# EasyEDA Pro project ZH_FLIGHT_H7B0.eprj, schematic Schematic1

## Sheets
1 P1: Create Date: 2022-11-23; Page Name: P1; Project Name: ZH_FLIGHT_H7B0; Schematic Name: Schematic1
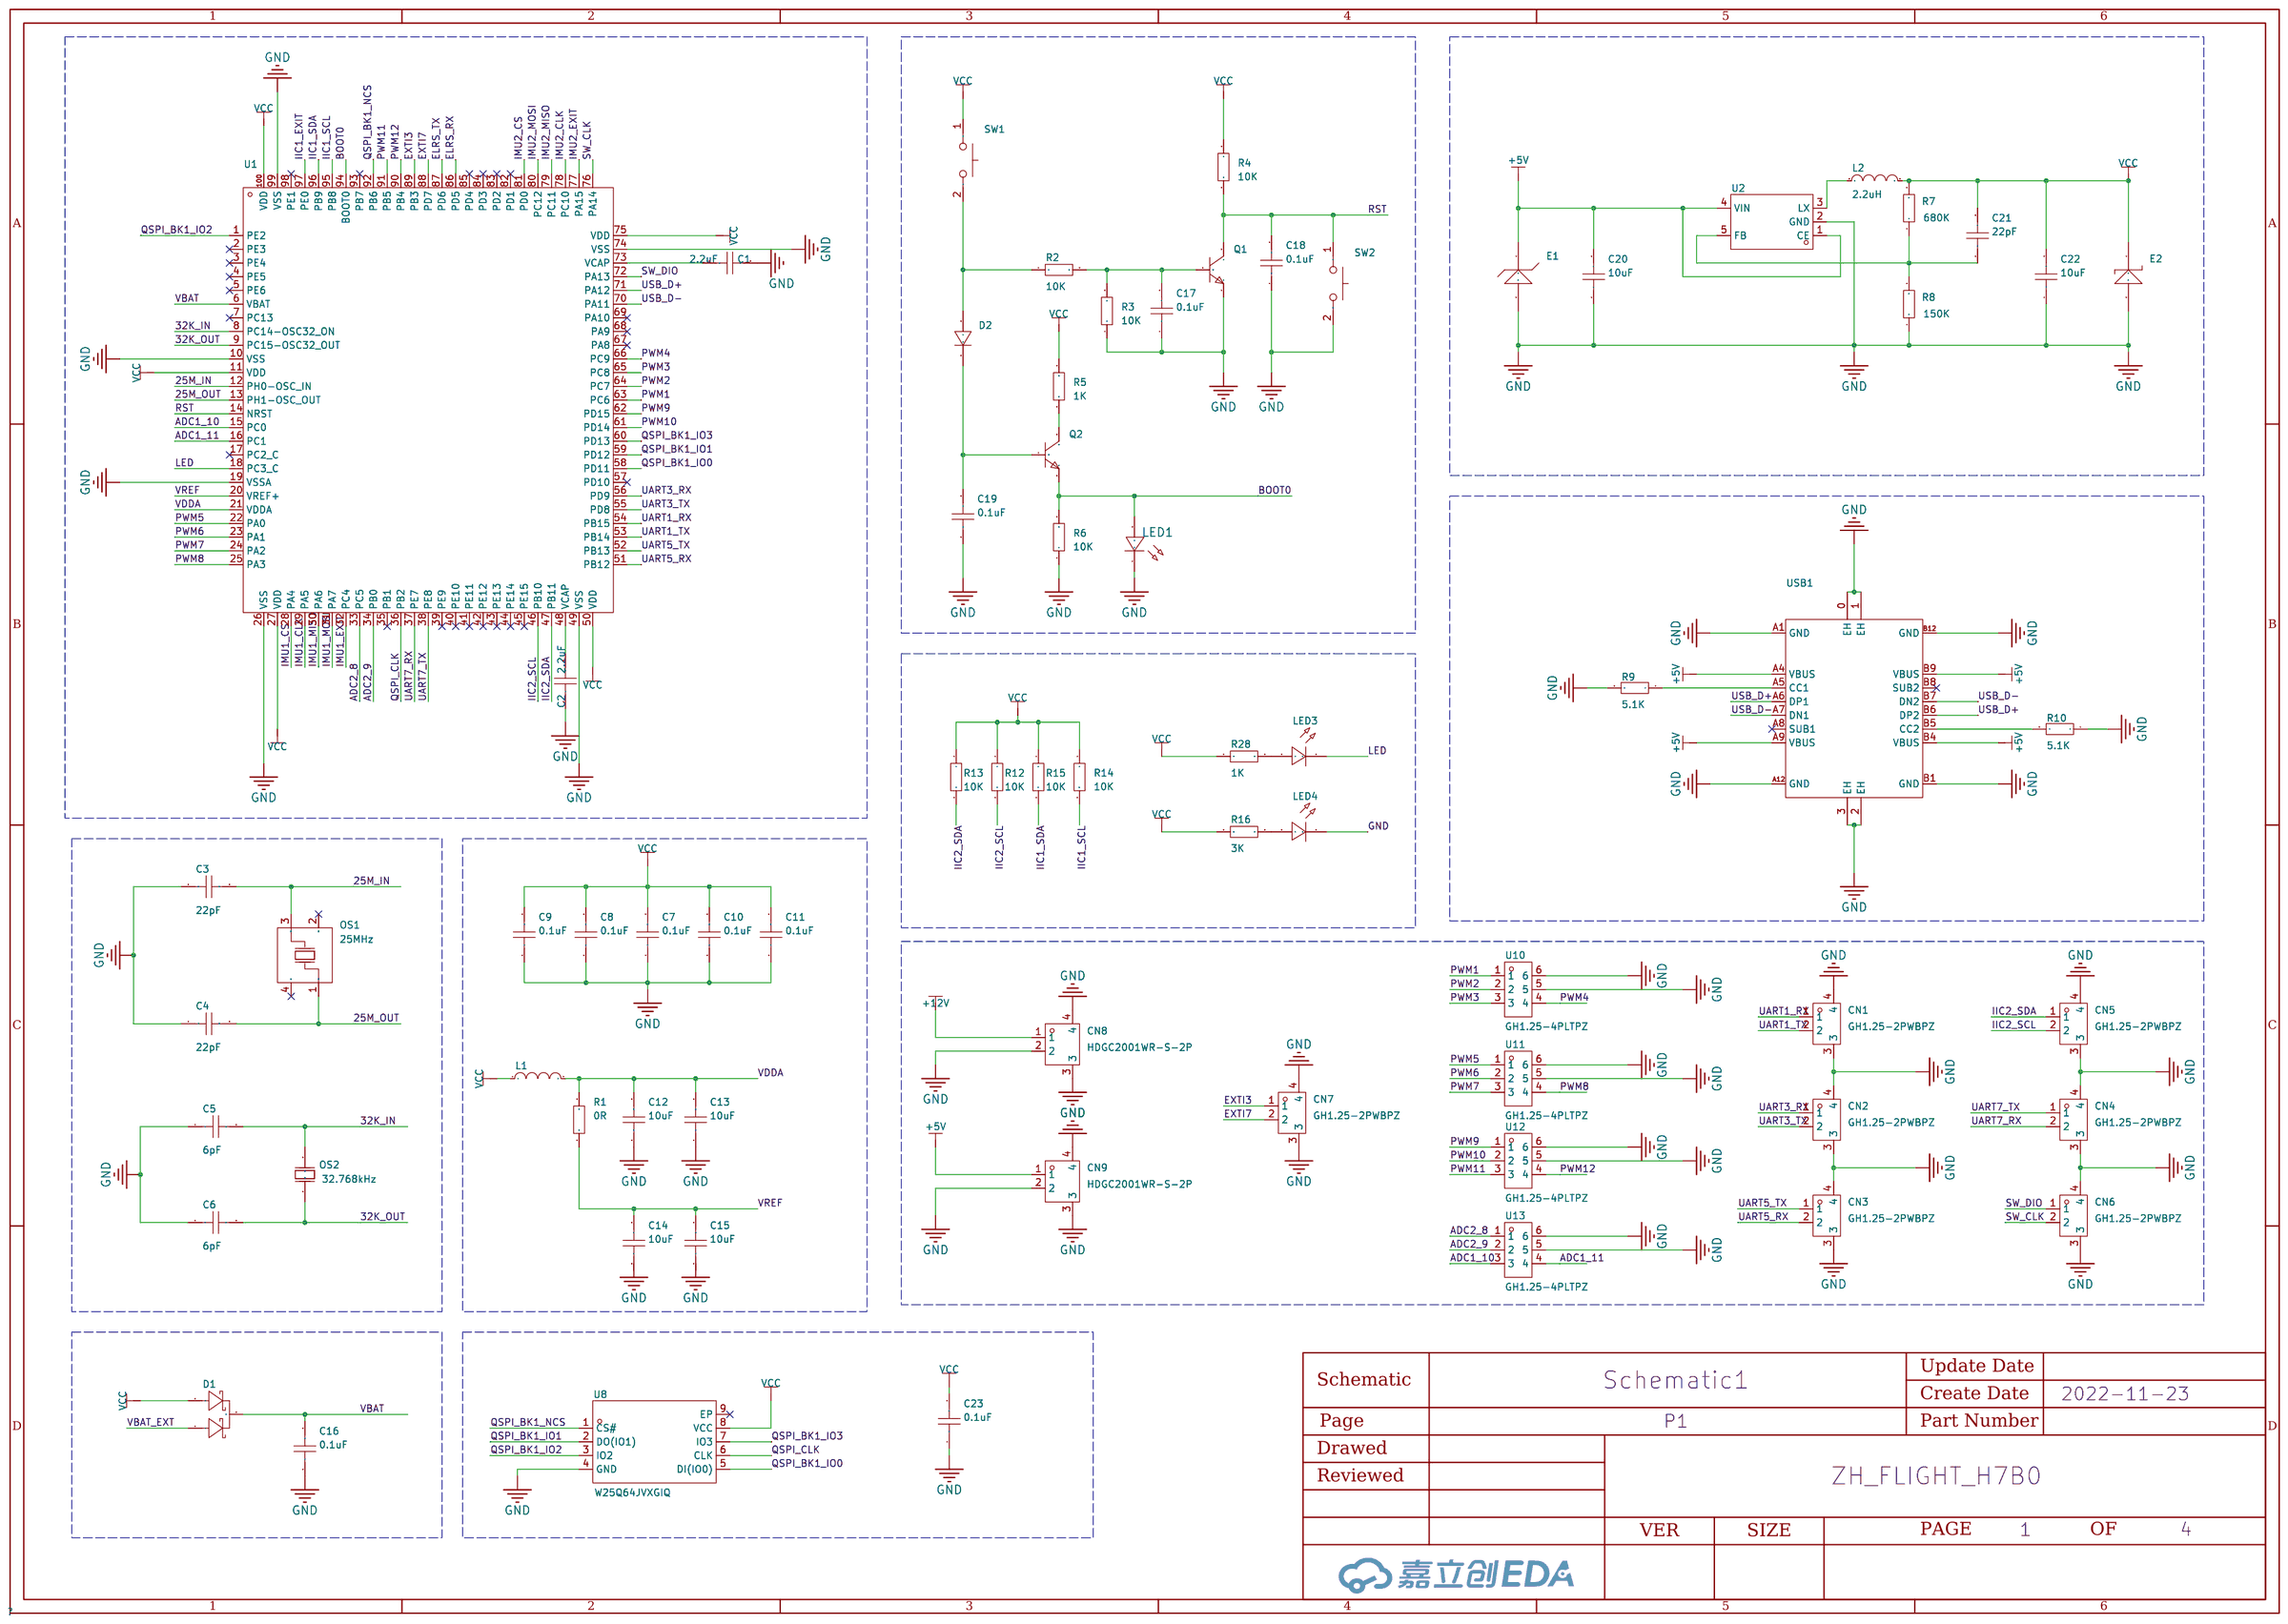
[diagram p0: P1]
2 P2: Create Date: 2022-11-27; Page Name: P2; Company: 嘉立创EDA; Page Size: A4; Version: V1.0
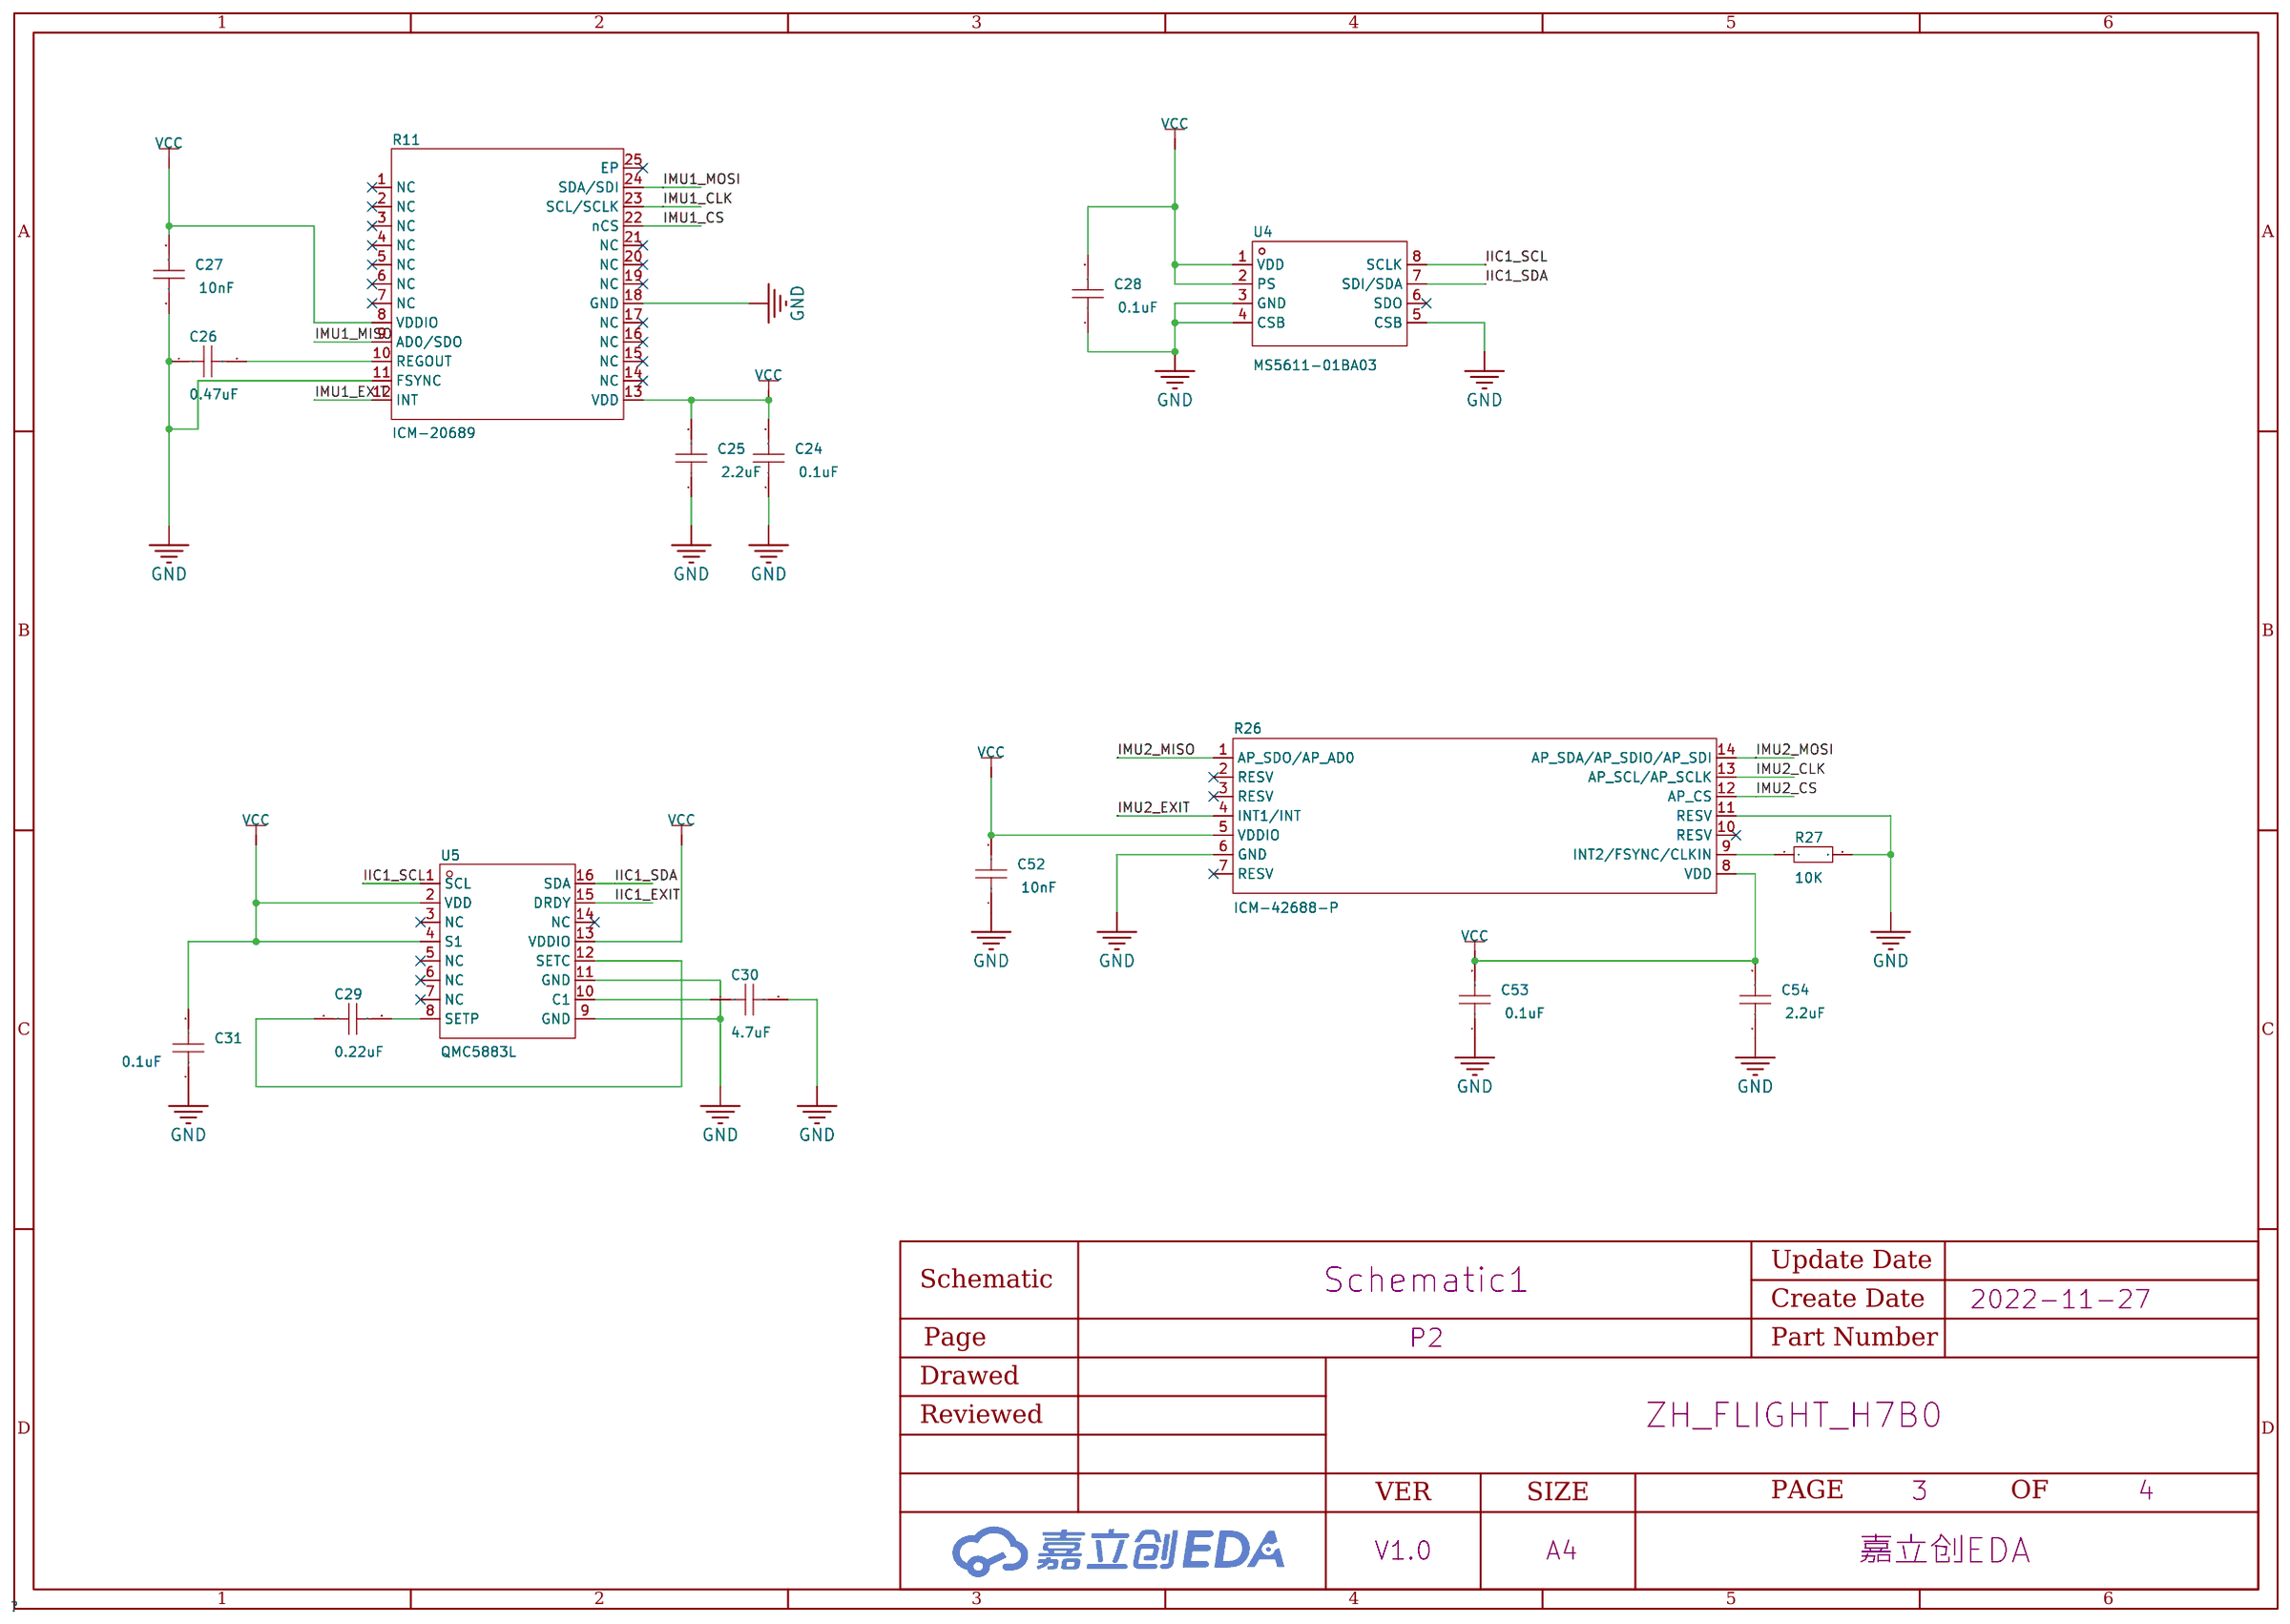
[diagram p1: P2]
3 P3: Create Date: 2022-11-28; Page Name: P3; Company: 嘉立创EDA; Page Size: A4; Version: V1.0
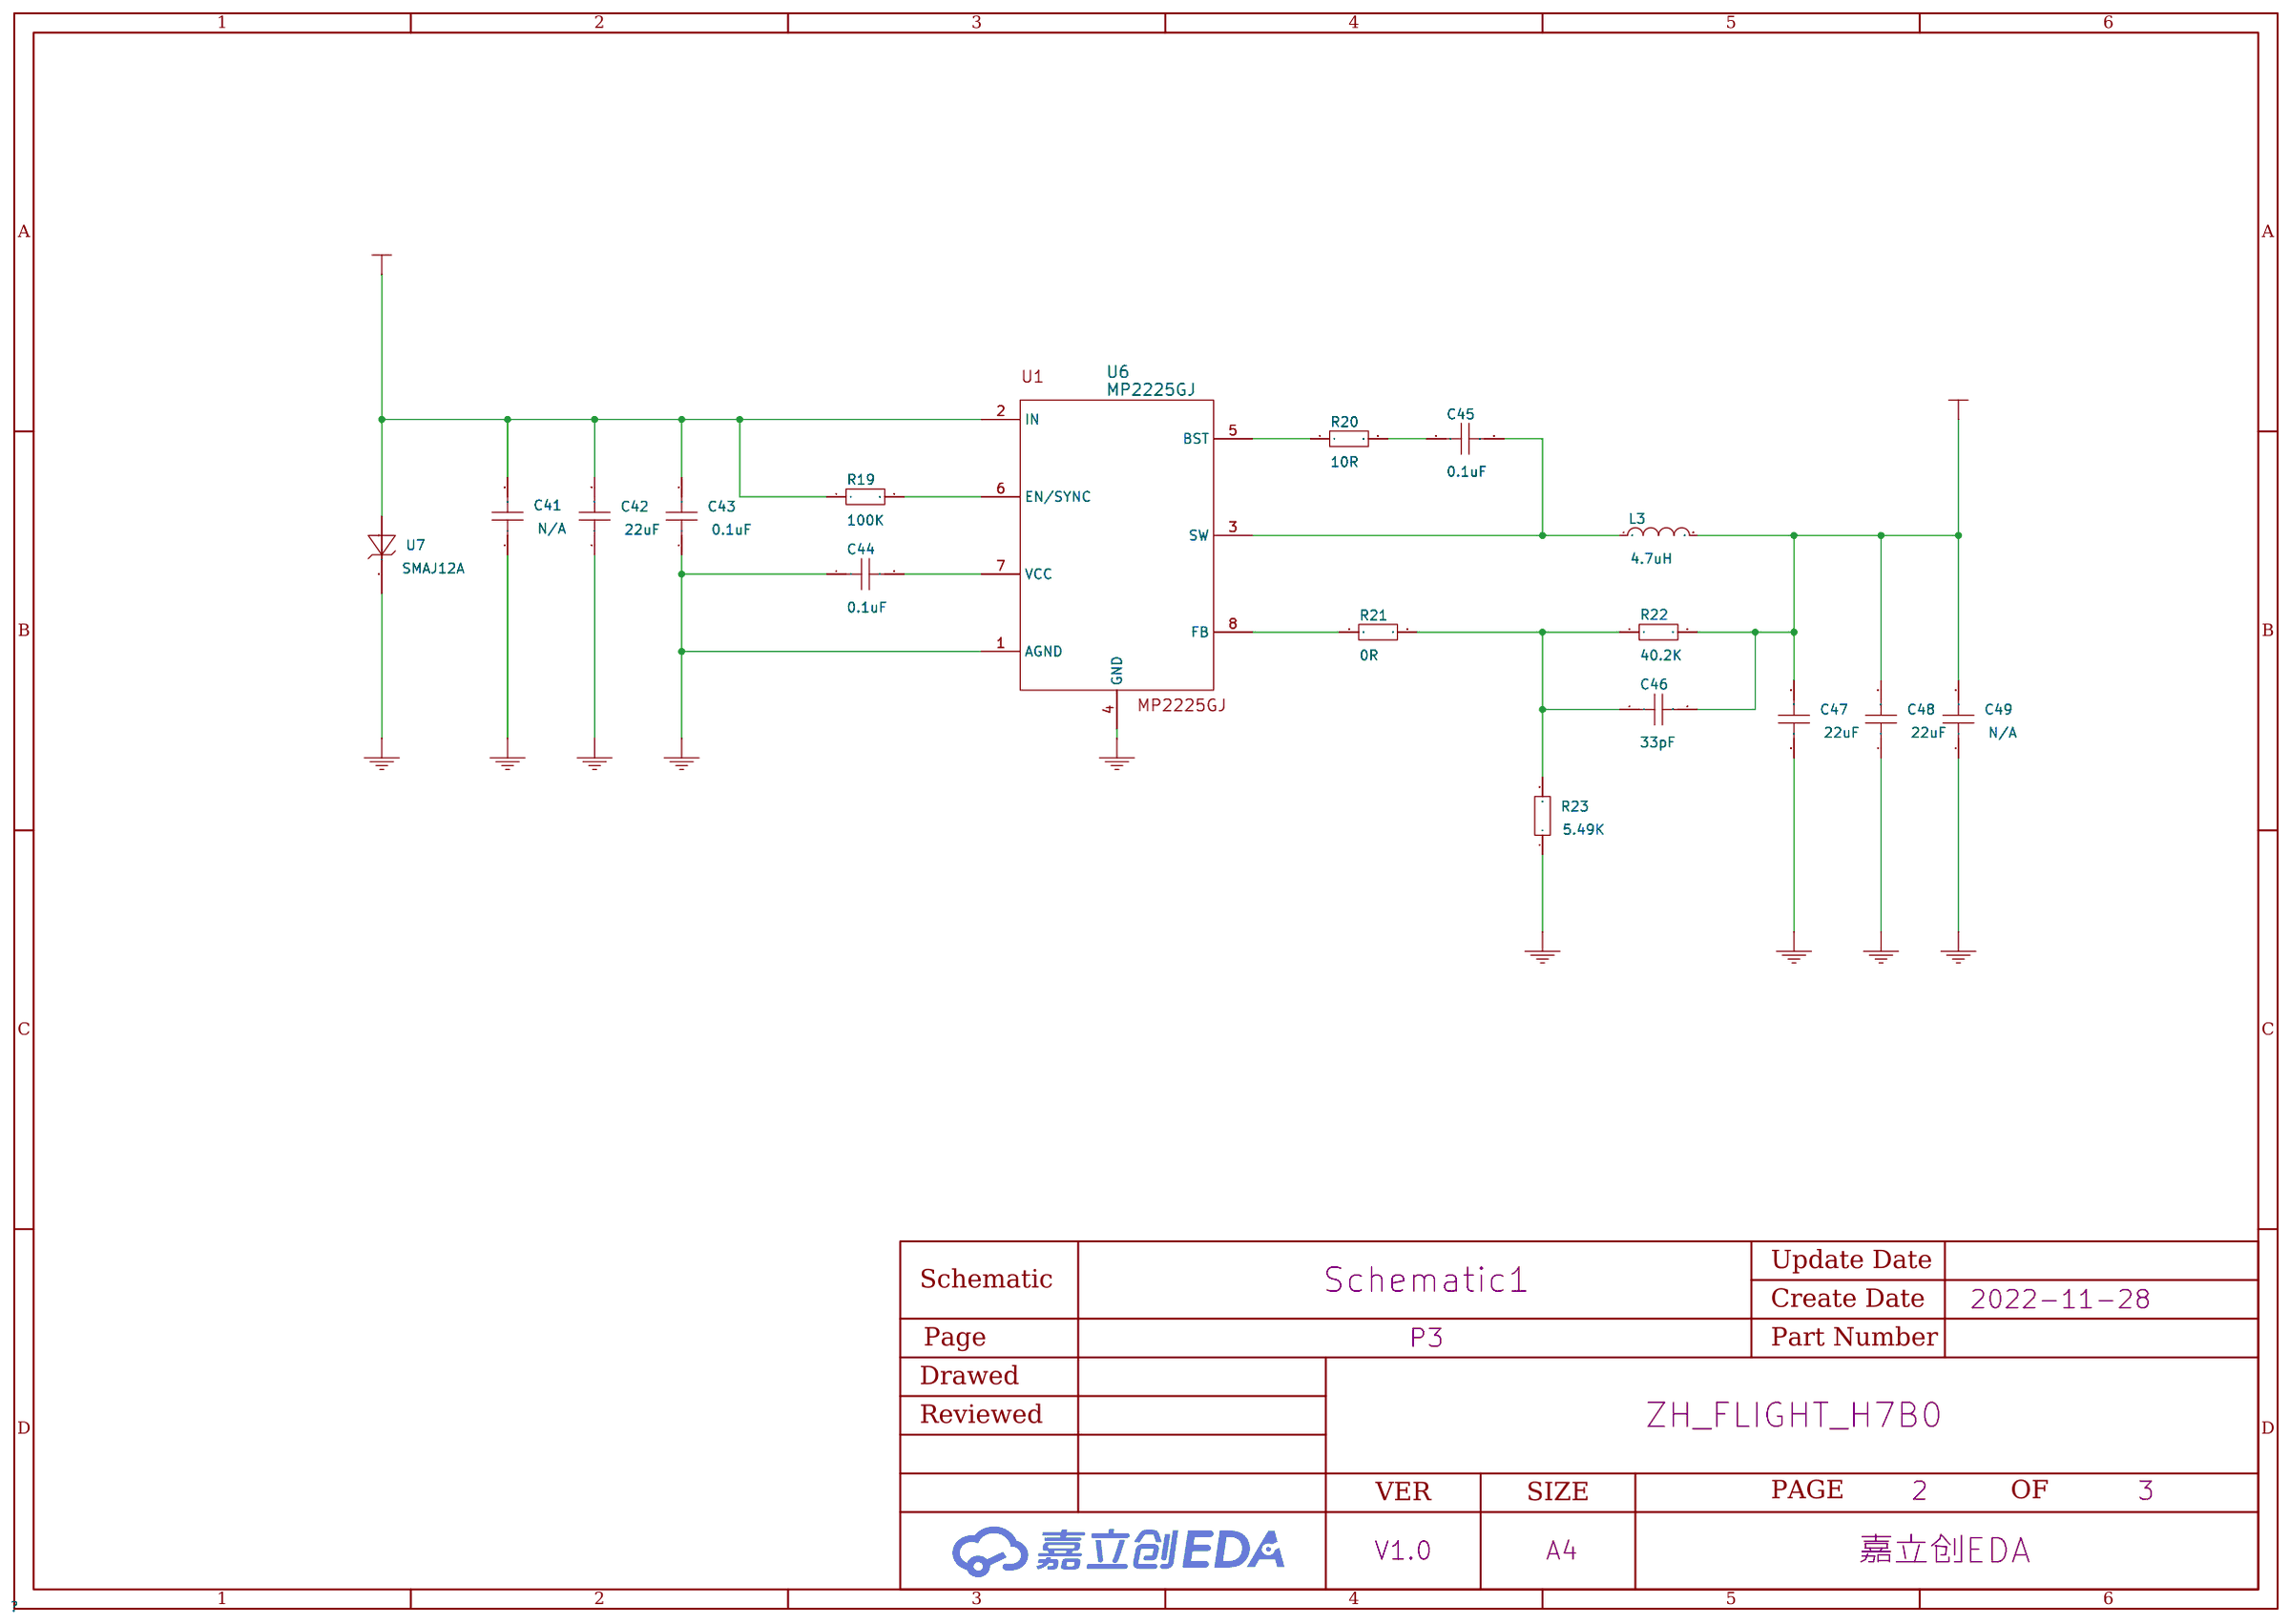
[diagram p2: P3]
4 P4: Create Date: 2022-12-03; Page Name: P4; Company: 嘉立创EDA; Page Size: A4; Version: V1.0